# EasyEDA Pro project ProPrj_Avaota A1 八核 AIoT 开发板_2024-05-03.epro, board PCB1 (continued)
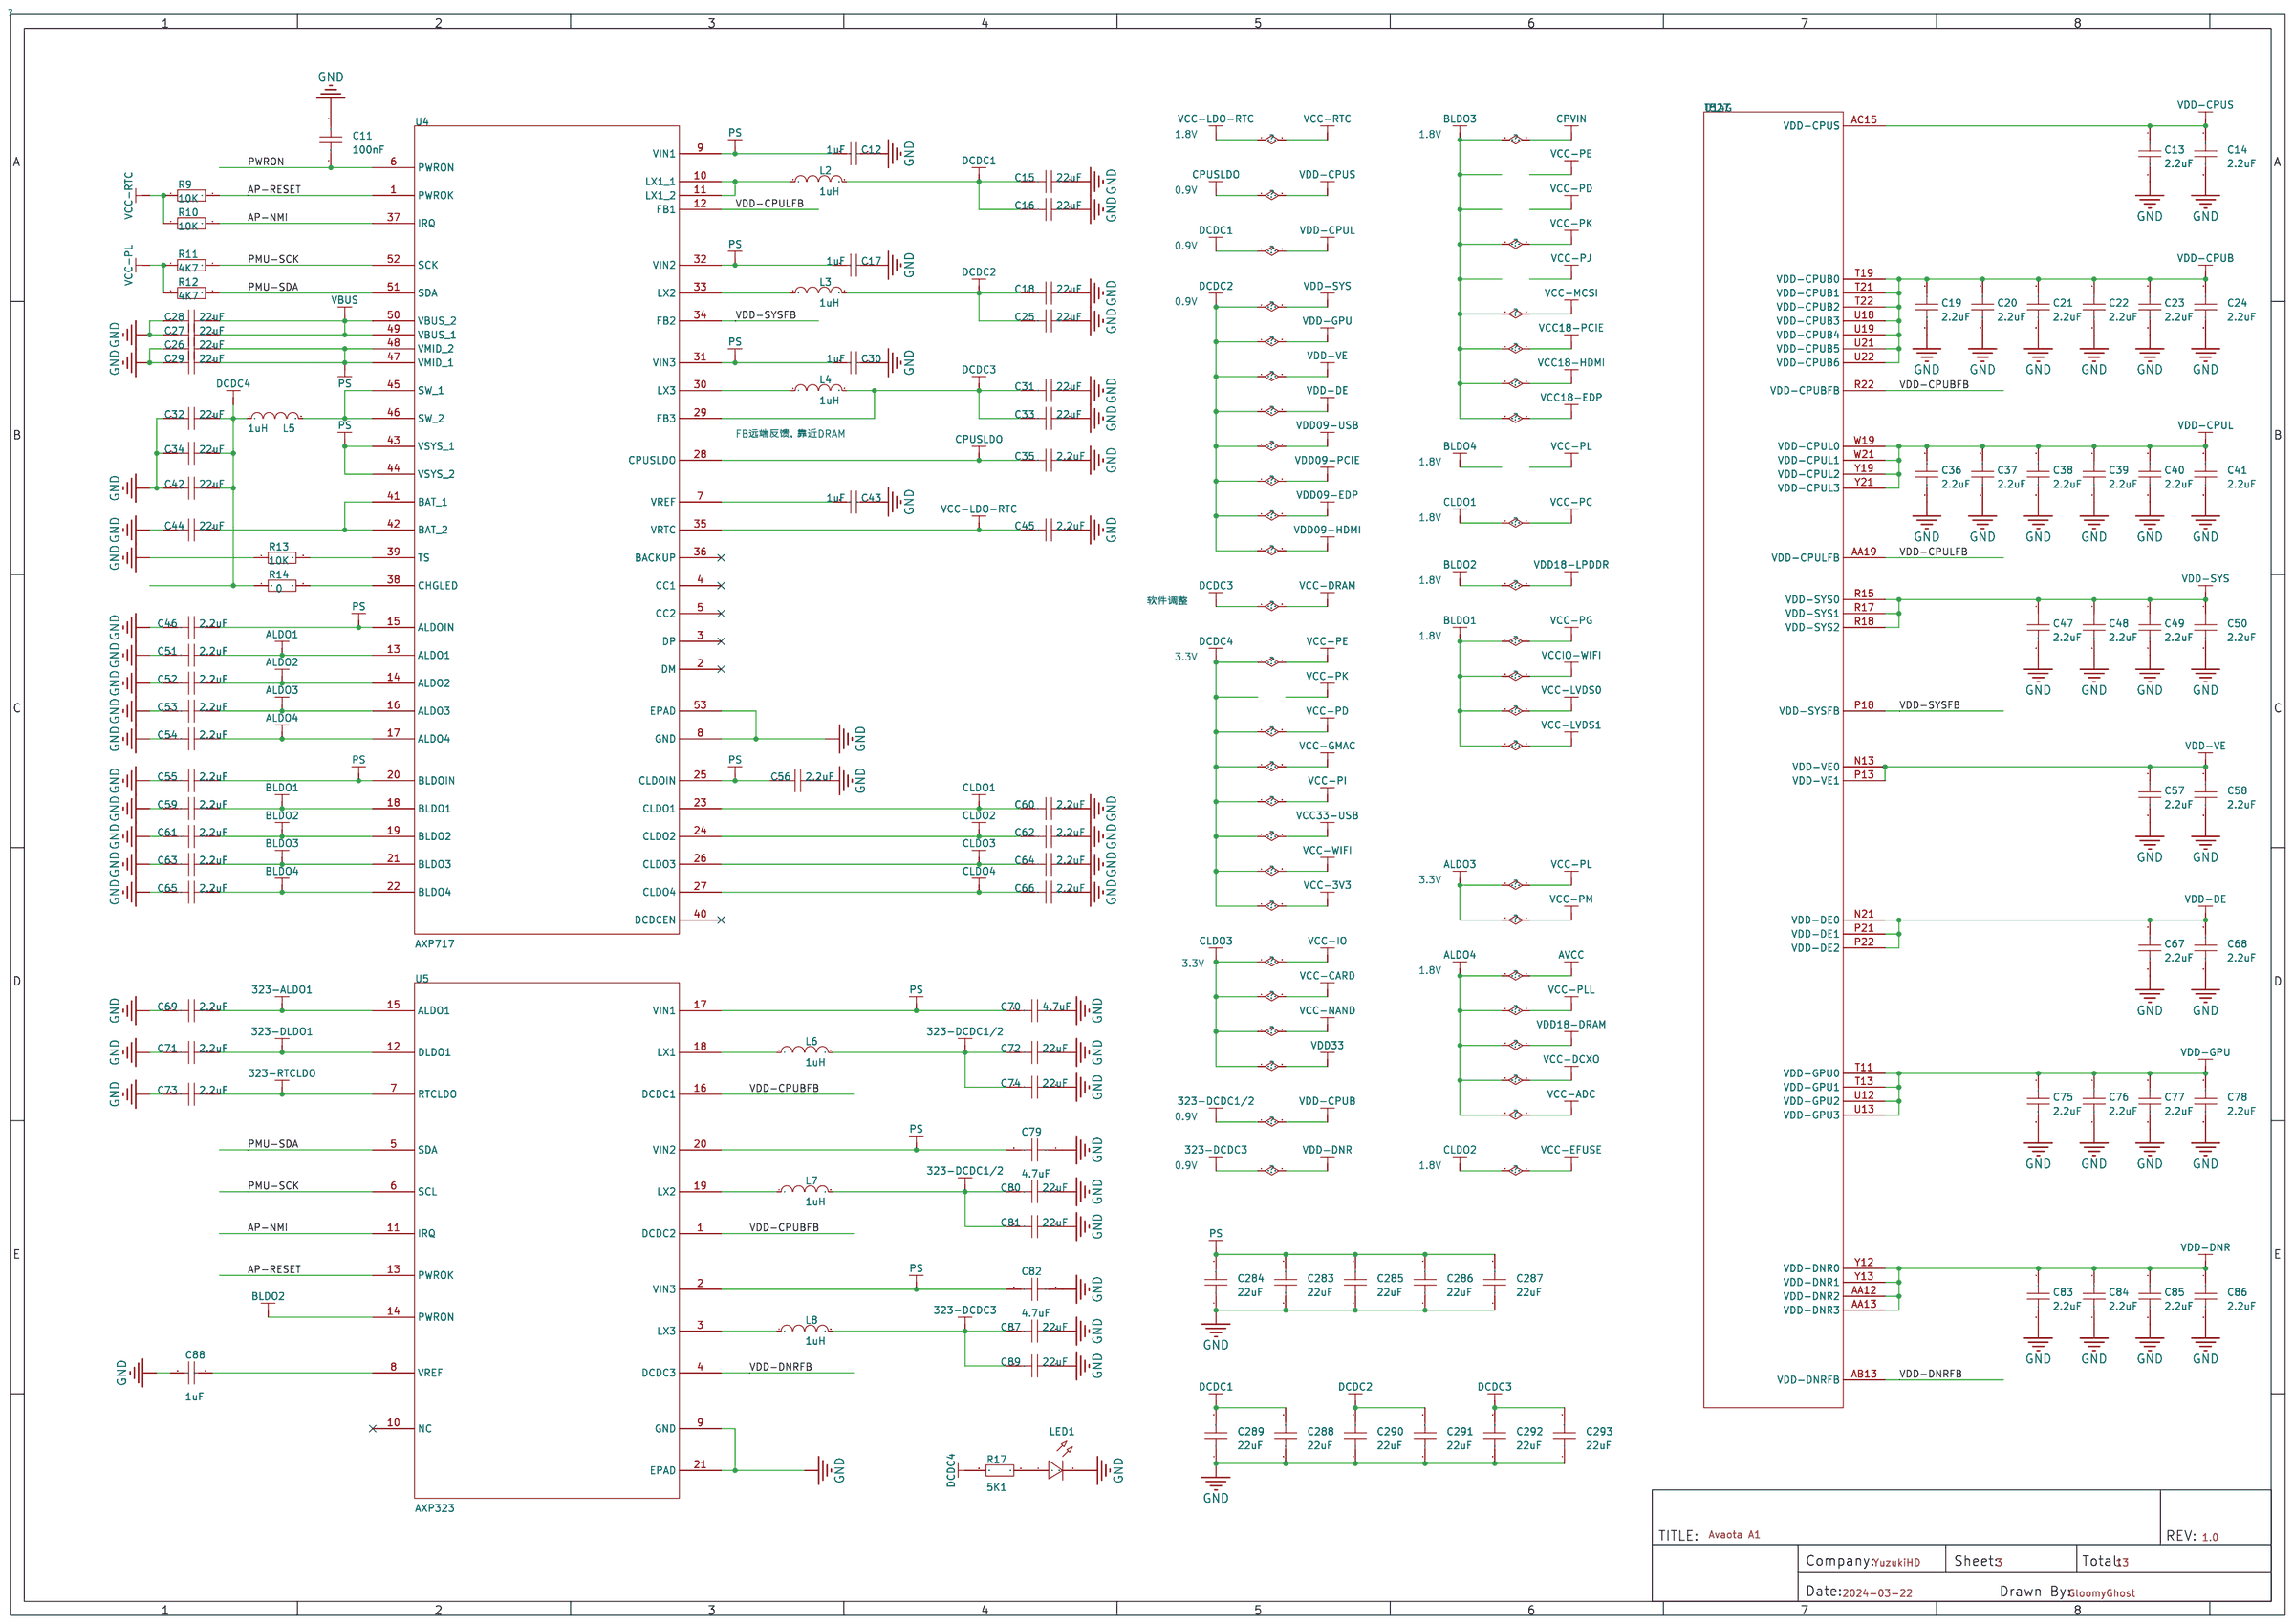
[diagram p0: POWER]
## Routing (per net, layer and track width the routed paths; a pad name or vN(x,y) marks a point on that pad's centre or on a via; arc(x,y) is an arc through that point) (continued)
SDQ3: length 21.4
  Top Layer w0.076: v3(53.92,39.01) 54.48,39.57 54.69,39.57 55.02,39.9 55.7,39.9 55.93,40.14
  Top Layer w0.115: 41.41,43.55 41.72,43.87 42.29,43.87 42.95,43.21 42.95,42.82 43.06,42.71 43.18,42.71 43.39,42.49 43.87,42.49 45.02,41.35 45.74,41.35 46.12,40.97 46.12,40.39 45.79,40.06 44.8,40.06 44.68,39.93 44.68,39.65 44.8,39.52 45.34,39.52 45.49,39.37 45.49,39.06 v3(45.44,39.01)
  内层2 w0.115: v3(45.44,39.01) 45.81,38.64 53.55,38.64 v3(53.92,39.01)
SDQ4: length 18.8
  Top Layer w0.115: 41.41,40.95 41.74,40.61 42.31,40.61 43,39.93 43.68,39.93 v3(44.04,40.29) ; 57.43,41.64 57.9,41.64 v3(57.94,41.68)
  内层2 w0.115: v3(57.94,41.68) 57.83,41.68 57.43,41.27 57.43,40.69 56.69,39.95 53.57,39.95 53.49,40.03 50.7,40.03 50.49,40.23 44.1,40.23 v3(44.04,40.29)
SDQ5: length 21.1
  Top Layer w0.076: 57.93,40.64 57.68,40.39 57.68,40.04 57.55,39.91 57.55,39.42 v3(57.14,39)
  Top Layer w0.115: 40.17,40.62 40.16,40.64 40.11,40.64 39.81,40.95
  内层2 w0.115: v3(40.17,40.62) 40.22,40.58 40.42,40.58 43.2,37.8 55.99,37.8 57.14,38.95 v3(57.14,39)
SDQ6: length 20.8
  Top Layer w0.115: 57.43,41.14 57.4,41.1 v3(56.97,41.1) ; 41.41,41.6 41.75,41.25 42.4,41.25 42.57,41.08 42.57,40.77 42.67,40.67 42.82,40.67 42.9,40.74 42.9,41.13 43.01,41.25 43.14,41.25 43.25,41.13 43.25,40.74 43.34,40.66 43.51,40.66 43.58,40.73 43.58,41.17 43.66,41.25 43.79,41.25 43.89,41.15 43.89,40.67 43.51,40.29 v3(43.36,40.29)
  内层2 w0.115: v3(43.36,40.29) 43.73,40.67 50.95,40.67 51.28,40.33 53.77,40.33 53.92,40.18 56.41,40.18 56.97,40.74 v3(56.97,41.1)
SDQ7: length 23.5
  Top Layer w0.076: v3(57.65,39) 57.65,39.13 57.76,39.24 57.76,39.86 57.86,39.96 57.86,40.07 57.93,40.14
  Top Layer w0.115: 39.81,41.6 39.74,41.6 v3(39.44,41.3)
  内层2 w0.115: v3(39.44,41.3) 39.77,40.97 39.77,40.28 39.5,40 39.5,39.67 41.79,37.38 56.18,37.38 57.65,38.85 v3(57.65,39)
SDQ8: length 28.1
  Top Layer w0.115: v3(58.85,42.88) 58.69,42.88 58.43,43.14 ; UD1.E9 36.35,42.57 36.8,42.57 37.16,42.52 37.49,42.57 v3(37.77,42.87)
  Inner5 w0.115: v3(37.77,42.87) 38.22,43.33 38.68,43.33 39.14,42.87 39.77,42.87 39.85,42.95 40.63,42.95 40.74,43.07 40.74,43.34 40.85,43.46 41.08,43.46 41.2,43.34 41.2,42.93 41.68,42.44 42.19,42.44 42.36,42.62 42.98,42.62 43.09,42.51 43.09,42.43 43.21,42.32 43.44,42.32 43.55,42.43 43.55,42.51 43.67,42.62 43.91,42.62 44.22,42.32 46.25,42.32 46.97,41.6 51.51,41.6 52.35,40.76 56.38,40.76 56.51,40.89 56.51,41.76 56.82,42.06 58.11,42.06 58.34,42.29 58.34,42.77 58.46,42.88 v3(58.85,42.88)
SDQ9: length 28.1
  Top Layer w0.115: 35.81,43.55 35.89,43.46 36.23,43.46 36.46,43.23 37.95,43.23 38.17,43 38.17,42.32 v3(38.56,41.94) ; 58.43,42.64 58.72,42.36 v3(58.82,42.36)
  Inner5 w0.115: v3(58.82,42.36) 58.82,42.21 58.29,41.68 58.29,40.92 57.68,40.31 51.92,40.31 51.46,40.77 46.78,40.77 46.14,41.41 45.98,41.41 45.74,41.17 45.62,41.17 45.49,41.3 45.49,41.44 45.38,41.55 44.47,41.55 44.06,41.15 42.95,41.15 42.47,40.67 41.92,40.67 41.81,40.78 41.81,40.92 40.99,41.73 40.16,41.73 39.62,42.27 38.67,42.27 38.56,42.15 v3(38.56,41.94)
SDQ10: length 26.9
  Top Layer w0.076: v3(58.9,41.64) 58.44,41.64 58.43,41.64
  Top Layer w0.115: 35.81,40.95 36.14,40.61 36.7,40.61 37.06,40.26 37.56,40.26 v3(37.87,40.56)
  Inner5 w0.115: v3(58.9,41.64) 58.83,41.64 58.52,41.33 58.52,40.61 57.99,40.08 51.56,40.08 51.29,40.35 46.7,40.35 46.32,40.73 45.26,40.73 45.15,40.84 45.15,41.06 45.03,41.17 44.81,41.17 44.69,41.06 44.69,40.84 44.58,40.73 43.12,40.73 42.68,40.28 41.54,40.28 41.43,40.4 41.43,40.74 41.25,40.92 40.64,40.92 40.59,40.97 39.7,40.97 39.65,40.92 37.98,40.92 37.87,40.8 v3(37.87,40.56)
SDQ11: length 26.1
  Top Layer w0.115: v3(38.53,40.56) 38.15,40.94 37.59,40.94 37.28,41.25 36.15,41.25 35.81,41.6 ; 58.43,41.14 58.47,41.1 v3(58.9,41.1)
  Inner5 w0.115: v3(38.53,40.56) 38.81,40.56 38.92,40.45 38.92,40.32 39.29,39.96 39.45,39.96 39.7,40.21 40.74,40.21 41.02,39.93 44.37,39.93 44.47,40.03 44.47,40.27 44.59,40.38 44.91,40.38 45.08,40.21 45.51,40.21 45.62,40.31 46.14,40.31 46.25,40.2 46.25,40.03 46.35,39.93 51.14,39.93 51.21,39.85 58.14,39.85 58.9,40.61 v3(58.9,41.1)
SDQ12: length 32.7
  Top Layer w0.115: 34.21,41.6 33.71,41.1 33.71,40.18 v3(33.3,39.78) ; 59.43,40.14 59.43,39.64 v3(59.5,39.57)
  Inner5 w0.115: v3(33.3,39.78) 35.7,37.38 59.09,37.38 59.84,38.12 59.84,38.38 60.22,38.76 60.22,39.12 59.76,39.57 v3(59.5,39.57)
SDQ13: length 31.5
  Top Layer w0.076: 59.27,39.31 59.42,39.25 v3(59.83,38.94) ; 59.27,39.31 59.13,39.45 59.13,39.7 59.18,39.75 59.18,40.89 59.43,41.14 ; 59.27,39.31 arc(59.27,39.31) 59.27,39.3
  Top Layer w0.115: 34.21,40.95 33.91,40.65 33.91,40.05 v3(34.19,39.78)
  Inner5 w0.115: v3(59.83,38.94) 59.83,38.75 59.54,38.46 59.54,38.23 59.1,37.79 35.79,37.79 34.19,39.4 v3(34.19,39.78)
SDQ14: length 32.5
  Top Layer w0.102: 59.43,42.64 59.89,42.64 v3(59.9,42.65)
  Top Layer w0.115: v3(33.88,43.18) 34.21,43.51 34.21,43.55
  Inner5 w0.115: 33.88,43.18 34.14,42.93 34.85,42.93 34.93,43.01 35.48,43.01 36.19,42.29 36.19,40.79 37.89,39.09 44.98,39.09 45.29,39.4 45.59,39.4 45.9,39.09 52.19,39.09 52.5,39.4 58.62,39.4 59.54,40.31 59.54,42.29 v3(59.9,42.65)
SDQ15: length 31.8
  Top Layer w0.115: v3(59.94,43.18) 59.47,43.18 59.43,43.14 ; v3(34.62,43.28) 34.59,43.28 34.21,42.9
  Inner5 w0.115: v3(59.94,43.18) 59.84,43.18 59.26,42.6 59.26,40.46 58.42,39.62 52.19,39.62 52.08,39.51 46.07,39.51 45.76,39.81 45.11,39.81 44.8,39.5 38.02,39.5 36.6,40.92 36.6,42.34 35.66,43.28 v3(34.62,43.28)
SDQ16: length 16.7
  Top Layer w0.076: 51.91,43.57 52.91,43.57 53.23,43.89 53.68,43.89 53.93,44.14
  Top Layer w0.115: UD1.U2 41.71,50.95 41.73,50.98 42.32,51 42.6,50.9 42.85,50.95 43.08,50.85 43.13,50.75 43.26,50.57 v3(43.38,50.22) ; 51.91,43.57 51.79,43.46 49.27,43.46 v3(47.27,45.47)
  内层2 w0.115: v3(43.38,50.22) 43.46,50.22 46.04,47.64 46.04,46.71 47.27,45.48 v3(47.27,45.47)
SDQ17: length 16.5
  Top Layer w0.115: 41.41,51.35 41.74,51.69 43,51.69 v3(43.33,51.36) ; v3(48,45.47) 48.03,45.44 48.03,45.26 49.58,43.71 51.69,43.71 51.86,43.89 52.88,43.89 53.13,44.14 53.43,44.14
  内层2 w0.115: v3(43.33,51.36) 43.33,50.94 46.45,47.81 46.45,46.89 47.88,45.47 v3(48,45.47)
SDQ18: length 24.1
  Top Layer w0.076: 55.93,45.14 55.93,44.75 v3(56.01,44.68)
  Top Layer w0.115: 39.81,50.7 39.78,50.7 v3(39.4,51.08)
  内层2 w0.115: v3(39.4,51.08) 39.14,51.34 39.14,53.14 39.39,53.39 46.2,53.39 51.46,48.13 51.84,48.13 53.62,46.35 53.62,45.97 54.29,45.3 55.54,45.3 56.01,44.83 v3(56.01,44.68)
SDQ19: length 18.9
  Top Layer w0.115: 41.41,52.65 41.54,52.65 41.85,52.96 43.25,52.96 43.72,52.49 43.72,51.36 43.97,51.12 46.06,51.12 v3(46.73,51.79) ; v3(54.96,44.68) 54.96,45.11 54.93,45.14
  内层2 w0.115: v3(46.73,51.79) 46.73,51.78 50.2,48.31 50.54,48.31 53.36,45.49 53.49,45.49 53.92,45.06 54.68,45.06 54.96,44.78 v3(54.96,44.68)
SDQ20: length 21.2
  Top Layer w0.076: v3(39.5,52.98) 39.5,51.66 39.81,51.35
  Top Layer w0.102: 54.43,45.14 v3(54.43,44.68)
  内层2 w0.115: v3(39.5,52.98) 39.52,53.01 45.9,53.01 46.31,52.59 46.31,51.61 50.01,47.92 50.34,47.92 53.02,45.24 53.36,45.24 53.92,44.68 v3(54.43,44.68)
SDQ21: length 17.3
  Top Layer w0.076: 53.93,45.64 53.68,45.89 53.31,45.89 53.21,45.8 52.3,45.8 v3(51.97,45.47)
  Top Layer w0.115: 41.41,53.3 41.49,53.3 41.91,53.72 41.91,54.05 42.11,54.25 42.44,54.25 42.85,53.85 43.63,53.85 45.62,51.87 45.73,51.87 45.84,51.75 v3(45.84,51.66)
  内层2 w0.115: v3(45.84,51.66) 45.84,51.48 49.83,47.5 50.11,47.5 51.97,45.64 v3(51.97,45.47)
SDQ22: length 20.7
  Top Layer w0.076: 51.6,45.99 53.15,45.99 53.3,46.14 53.43,46.14
  Top Layer w0.115: v3(51.38,45.47) 51.43,45.47 51.46,45.49 51.46,45.85 51.6,45.99 ; v3(45.82,52.55) 45.41,52.55 43.74,54.23 43.56,54.23 42.8,54.99 40.64,54.99 40.16,54.51 40.16,53.65 39.81,53.3
  内层2 w0.115: v3(51.38,45.47) 51.38,45.63 49.94,47.08 49.66,47.08 45.43,51.31 45.43,52.16 v3(45.82,52.55)
SDQ23: length 22.2
  Top Layer w0.102: v3(56.55,45.72) 56.53,45.72 56.43,45.82 56.43,45.89 ; 56.43,46.14 56.43,45.89 ; 56.43,45.89 56.43,46.14
  Top Layer w0.115: 39.81,52.65 40,52.65 40.31,52.96 40.71,52.96 40.99,53.24 40.99,53.31 41.3,53.62 41.5,53.62 41.7,53.82 41.7,54.15 42.11,54.56 42.59,54.56 42.69,54.46 v3(42.82,54.46)
  内层2 w0.115: v3(42.82,54.46) 45.72,54.46 51.59,48.59 51.97,48.59 54.4,46.15 56.12,46.15 v3(56.55,45.72)
SDQ24: length 25.9
  Top Layer w0.102: v3(56.54,46.68) 56.43,46.78 56.43,47.14
  Top Layer w0.115: v3(36.17,53.7) 36.17,53.66 35.81,53.3
  Inner5 w0.115: v3(56.54,46.68) 56.54,46.89 55.78,47.65 55.23,47.65 54.51,48.37 54.51,48.39 54.2,48.69 51.51,48.69 49.38,50.83 49.38,50.99 45.37,54.99 37.41,54.99 36.88,54.46 36.88,54.05 36.6,53.77 36.24,53.77 v3(36.17,53.7)
SDQ25: length 27.2
  Top Layer w0.115: 56.01,47.07 55.93,47.14 ; v3(37.69,54.61) 37.39,54.91 35.13,54.91 34.57,54.36 34.57,53.66 34.21,53.3 ; 56.01,47.07 v3(56.01,46.68)
  Inner5 w0.115: v3(56.01,46.68) 56.01,46.79 55.52,47.27 55.01,47.27 53.87,48.41 51.13,48.41 48.96,50.58 48.96,50.81 45.68,54.09 40.73,54.09 40.36,54.46 39.04,54.46 38.81,54.23 38.07,54.23 v3(37.69,54.61)
SDQ26: length 27
  Top Layer w0.102: 54.93,47.14 54.93,46.71 v3(54.96,46.68)
  Top Layer w0.115: 34.21,51.35 34.57,51.71 v3(34.57,51.71)
  Inner5 w0.115: v3(34.57,51.71) 34.21,52.07 34.21,53.19 34.44,53.42 35.05,53.42 35.18,53.29 36.58,53.29 36.96,53.67 37.79,53.67 38.02,53.9 38.96,53.9 39.09,54.03 40.31,54.03 40.66,53.67 45.39,53.67 48.54,50.52 48.54,50.41 50.84,48.11 53.59,48.11 54.96,46.73 v3(54.96,46.68)
SDQ27: length 24.4
  Top Layer w0.115: v3(34.59,53.01) 34.57,53.01 34.21,52.65 ; 54.43,47.14 v3(54.43,46.68)
  Inner5 w0.115: v3(54.43,46.68) 53.77,47.35 51.01,47.35 46.95,51.41 46.56,51.41 46.3,51.66 46.3,51.79 46,52.1 45.62,52.1 44.49,53.23 41.95,53.23 41.81,53.37 40.46,53.37 40.1,53.72 39.22,53.72 39.11,53.62 38.07,53.62 37.82,53.37 37.54,53.37 37.41,53.24 37.41,52.98 37.26,52.83 34.77,52.83 v3(34.59,53.01)
SDQ28: length 21.8
  Top Layer w0.076: 53.93,46.14 53.68,46.39 53.32,46.39 53.11,46.18 51.69,46.18 51.53,46.33 51.16,46.33
  Top Layer w0.115: 51.16,46.33 50.37,46.33 50.09,46.05 49.3,46.05 49.15,45.9 48.33,45.9 47.27,46.96 v3(47.27,47.2) ; 35.81,50.7 35.97,50.7 36.29,51.03 36.75,51.03 37.03,50.75 v3(37.64,50.75)
  Inner5 w0.115: v3(37.64,50.75) 37.64,50.41 37.75,50.29 38.83,50.29 39.16,49.96 39.62,49.96 39.88,50.22 40.49,50.22 40.69,50.01 41.48,50.01 41.55,49.94 42.03,49.94 42.54,49.43 43.12,49.43 43.47,49.07 43.86,49.07 44.09,49.3 44.39,49.3 44.99,48.7 46.09,48.7 46.63,48.16 46.63,47.82 47.26,47.2 v3(47.27,47.2)
SDQ29: length 25
  Top Layer w0.115: 54.43,46.14 v3(54.43,45.68) ; v3(33.8,50.95) 34.06,50.7 34.21,50.7
  Inner5 w0.115: v3(54.43,45.68) 53.96,45.68 53.76,45.88 52.59,45.88 52.18,46.29 48.19,46.29 47.78,46.71 47.14,46.71 45.57,48.29 44.3,48.29 43.93,48.65 43.3,48.65 42.95,49.01 42.45,49.01 41.91,49.56 41.43,49.56 41.25,49.73 40.59,49.73 40.36,49.96 40,49.96 39.78,49.73 39.04,49.73 38.81,49.5 36.68,49.5 36.5,49.33 34.3,49.33 34.19,49.44 34.19,50.57 v3(33.8,50.95)
SDQ30: length 23.2
  Top Layer w0.102: 35.81,52.65 35.91,52.76 36.22,52.76 36.4,52.93 36.78,52.93 36.96,52.86 37.36,52.93 37.72,52.58 38.45,52.58 v3(38.48,52.55) ; 54.93,46.14 54.93,45.71 v3(54.96,45.68)
  Inner5 w0.115: v3(54.96,45.68) 54.59,46.05 53.95,46.05 53.74,46.25 52.65,46.25 52.25,46.66 50.51,46.66 46.72,50.44 45.81,50.44 44.29,51.97 41.65,51.97 41.4,52.22 41.4,52.55 41.22,52.73 40.49,52.73 40.23,52.48 39.04,52.48 38.96,52.55 v3(38.48,52.55)
SDQ31: length 24.9
  Top Layer w0.115: v3(37.79,52.2) 37.79,52.17 37.31,51.68 36.47,51.68 36.13,51.35 35.81,51.35 ; v3(56.01,45.68) 56.01,46.07
  Inner5 w0.115: v3(56.01,45.68) 56.01,45.77 55.5,46.28 54.23,46.28 53.49,47.02 50.75,47.02 46.81,50.95 45.89,50.95 44.04,52.81 41.78,52.81 41.53,53.06 40.18,53.06 39.85,53.39 39.29,53.39 39.01,53.11 39.01,53.02 38.9,52.91 38.28,52.91 37.79,52.43 v3(37.79,52.2)
SDQM0: length 19.5
  Top Layer w0.076: 57.43,40.15 57.39,39.97 57.35,39.74 v3(56.61,39)
  Top Layer w0.115: v3(40.89,41.27) 40.89,41.31 40.61,41.6
  内层2 w0.115: v3(56.61,39) 56.6,39 56.6,38.95 55.87,38.22 43.49,38.22 41.68,40.03 41.68,40.41 40.89,41.2 v3(40.89,41.27)
SDQM1: length 26.3
  Top Layer w0.115: v3(57.94,41.15) 58.43,40.65 58.43,40.64 ; 35.01,41.6 35.32,41.6 35.63,41.91 36.9,41.91 37.01,41.81 37.77,41.81 v3(37.89,41.94)
  Inner5 w0.115: v3(37.89,41.94) 37.74,42.09 37.74,42.32 38.05,42.62 39.65,42.62 40.13,42.14 41.09,42.14 42.06,41.17 42.44,41.17 42.83,41.56 43.98,41.56 44.35,41.94 46.15,41.94 46.9,41.19 51.55,41.19 52.19,40.54 57.33,40.54 v3(57.94,41.15)
SDQM2: length 19.9
  Top Layer w0.076: 53.93,44.64 53.68,44.39 53.02,44.39 52.78,44.14 51.79,44.14
  Top Layer w0.115: v3(44.14,51.54) 44.14,52.7 43.46,53.39 42.62,53.39 42.39,53.62 42.13,53.62 41.78,53.28 41.78,53.21 41.53,52.96 41.02,52.96 40.71,52.65 40.61,52.65 ; v3(48.54,45.47) 48.54,45.18 49.75,43.97 51.46,43.97 51.64,44.14 51.79,44.14
  内层2 w0.115: v3(48.54,45.47) 47.7,46.3 47.63,46.3 46.89,47.05 46.89,47.97 44.17,50.69 44.17,50.7 44.12,50.75 44.12,51.51 v3(44.14,51.54)
SDQM3: length 23.5
  Top Layer w0.076: 53.43,46.64 53.33,46.64 53.06,46.38 51.77,46.38 51.53,46.62
  Top Layer w0.115: v3(47.27,47.78) 47.37,47.78 47.75,47.4 47.75,46.89 48.44,46.2 48.99,46.2 49.07,46.28 49.91,46.28 50.25,46.62 51.53,46.62 ; v3(34.62,52.32) 34.94,52.65 35.01,52.65
  Inner5 w0.115: v3(34.62,52.32) 35,51.94 35,51.49 35.66,50.83 37.16,50.83 37.44,51.1 38.43,51.1 38.81,50.72 39.62,50.72 39.77,50.57 40.49,50.57 40.66,50.75 41.96,50.75 42.31,50.39 42.31,50.19 42.65,49.85 44.43,49.85 45.16,49.12 46.17,49.12 47.01,48.29 47.01,48.03 v3(47.27,47.78)
SDQS0N: length 19.7
  Top Layer w0.076: 56.93,40.14 56.89,40.1 56.89,39.94 56.6,39.65 56.42,39.65 56.14,39.37 55.67,39.37 55.54,39.23 v3(55.54,39.03)
  Top Layer w0.097: v3(40.93,42.57) 40.61,42.9
  内层2 w0.127: v3(55.54,39.03) 55.54,39.18 55.03,39.69 52.26,39.69 52.09,39.52 48.54,39.52 48.33,39.73 43.23,39.73 42.53,40.43 42.53,40.68 41.22,42 40.8,42 40.63,42.18 40.63,42.45 40.75,42.57 v3(40.93,42.57)
SDQS0P: length 20.1
  Top Layer w0.076: 56.93,40.64 56.93,40.5 56.69,40.26 56.69,40.03 56.49,39.83 56.34,39.83 56.06,39.55 55.5,39.55 v3(54.98,39.03)
  Top Layer w0.127: 40.61,42.25 40.58,42.25 v3(40.26,42.57)
  内层2 w0.127: v3(40.26,42.57) 40.33,42.5 40.33,42.06 40.68,41.71 41.1,41.71 42.24,40.56 42.24,40.31 43.11,39.44 48.21,39.44 48.42,39.23 52.21,39.23 52.38,39.4 54.61,39.4 v3(54.98,39.03)
SDQS1N: length 30.2
  Top Layer w0.076: v3(59.23,38.96) 58.93,39.26 58.93,40.14
  Top Layer w0.127: 35.01,42.9 35.01,42.88 v3(34.69,42.57)
  Inner5 w0.127: v3(34.69,42.57) 34.69,42.57 34.8,42.47 34.8,42.19 35.01,41.97 35.01,39.46 36.17,38.3 58.88,38.3 59.18,38.59 59.18,38.91 v3(59.23,38.96)
SDQS1P: length 30.3
  Top Layer w0.076: 58.93,40.64 58.68,40.39 58.69,40.05 58.69,39.72 ; v3(58.67,38.96) 58.67,39.09 58.68,39.1 58.68,39.26 58.61,39.34 58.47,39.34 58.37,39.43 58.37,39.54 58.47,39.64 58.61,39.64 58.68,39.72
  Top Layer w0.127: v3(35.33,42.57) 35.01,42.25
  Inner5 w0.127: v3(58.67,38.96) 58.76,38.96 58.89,38.84 58.89,38.72 58.76,38.59 36.29,38.59 35.3,39.58 35.3,42.09 35.09,42.31 35.09,42.44 35.22,42.57 v3(35.33,42.57)
SDQS2N: length 18.8
  Top Layer w0.076: 50.53,44.6 52.2,44.6 52.78,45.19 53.1,45.19 53.17,45.11 53.17,45.03 53.25,44.95 53.36,44.95 53.43,45.03 53.43,45.14
  Top Layer w0.127: v3(49.66,45.47) 49.76,45.47 49.93,45.29 49.93,44.93 50.26,44.6 50.53,44.6 ; 40.61,51.35 40.99,51.74 v3(40.99,51.76)
  内层2 w0.127: v3(40.99,51.76) 40.99,51.83 41.12,51.96 41.28,51.96 41.49,51.74 43.53,51.74 43.9,52.11 44.36,52.11 44.63,51.83 44.63,50.95 47.69,47.89 47.69,47.03 48.79,45.92 49.72,45.92 49.9,45.74 49.9,45.61 49.76,45.47 v3(49.66,45.47)
SDQS2P: length 18.8
  Top Layer w0.076: 53.93,45.14 53.68,45.39 52.7,45.39 52.11,44.81 50.8,44.81 50.69,44.91 50.59,44.91
  Top Layer w0.127: v3(50.24,45.47) 50.19,45.41 50.19,45.03 50.32,44.91 50.58,44.91 50.59,44.91 ; v3(40.99,52.35) 40.98,52.34 40.95,52.34 40.61,52
  内层2 w0.127: v3(50.24,45.47) 50.19,45.52 50.19,45.87 49.84,46.21 48.91,46.21 47.98,47.15 47.98,48.01 44.92,51.07 44.92,51.96 44.48,52.4 43.78,52.4 43.41,52.03 41.62,52.03 41.4,52.25 41.09,52.25 v3(40.99,52.35)
SDQS3N: length 22.2
  Top Layer w0.076: 51.57,47.14 52.04,47.14 52.12,47.07 52.12,46.89 52.2,46.82 52.35,46.82 52.42,46.89 52.42,47.07 52.5,47.14 53.43,47.14
  Top Layer w0.127: v3(48.75,46.9) 48.99,47.14 51.57,47.14 ; 35.01,51.35 35.01,51.35 v3(35.35,51.69)
  Inner5 w0.127: v3(35.35,51.69) 35.35,51.82 35.48,51.94 35.68,51.94 35.92,51.7 37.22,51.7 37.38,51.54 38.05,51.54 38.38,51.87 39.8,51.87 40.56,51.1 42.01,51.1 42.47,50.65 44.4,50.65 45.41,49.63 46.41,49.63 47.65,48.4 47.65,47.55 48.14,47.05 48.58,47.05 48.73,46.9 v3(48.75,46.9)
SDQS3P: length 22.1
  Top Layer w0.076: 51.57,47.4 51.67,47.4 51.72,47.35 53.15,47.35 53.2,47.39 53.57,47.39 53.82,47.14 53.93,47.14
  Top Layer w0.127: v3(48.74,47.41) 48.76,47.4 51.57,47.4 ; v3(35.41,52.37) 35.03,52 35.01,52
  Inner5 w0.127: v3(48.74,47.41) 48.67,47.35 48.26,47.35 47.94,47.67 47.94,48.52 46.54,49.92 45.53,49.92 44.52,50.94 42.56,50.94 42.1,51.4 40.68,51.4 39.92,52.16 38.26,52.16 37.93,51.83 37.5,51.83 37.34,51.99 36.04,51.99 35.8,52.23 35.55,52.23 v3(35.41,52.37)
SPI0-CLK: length 19.1
  Top Layer w0.102: R123.1 65.23,59.6 65.23,64.01 64.82,64.41 64.82,65.02 64.26,65.58 61.32,65.58 arc(61.18,65.64) 61.13,65.77 61.13,66.08 arc(60.94,66.27) 60.75,66.08 60.75,65.77 arc(60.56,65.58) 60.36,65.77 60.36,66.08 arc(60.17,66.27) 59.98,66.08 59.98,65.77 arc(59.79,65.58) 59.6,65.77 59.6,66.08 arc(59.41,66.27) 59.22,66.08 59.22,65.77 arc(59.17,65.64) 59.03,65.58 58.95,65.58 58.75,65.38 58.27,65.38 57.89,65 57.89,63.98 v1(58.42,63.45)
  Bottom Layer w0.102: 57.49,63.73 58.14,63.73 v1(58.42,63.45)
SPI0-CS: length 20.7
  Top Layer w0.076: 65.68,58.9 65.68,58.77 65.53,58.62 65.53,57.22 65.2,56.88 65.2,55.4 64.94,55.14
  Top Layer w0.102: 65.68,58.9 65.68,59.69 65.48,59.89 65.48,64.31 65.13,64.67 65.13,65.33 64.49,65.96 63.37,65.96 63.09,66.24 61.85,66.24 61.72,66.37 61.72,66.7 61.85,66.83 63.25,66.83 v1(63.68,66.4)
  Bottom Layer w0.102: R73.1 65.09,66.73 65.42,66.4 ; 65.42,66.4 v1(63.68,66.4) ; 65.42,66.4 65.55,66.27
SPI0-HOLD: length 15.9
  Top Layer w0.076: 64.24,58.99 64.24,58.45 63.88,58.09 63.88,56.08 63.44,55.64
  Top Layer w0.102: v1(58.62,64.59) 60.02,63.2 63.3,63.2 64.24,62.26 64.24,58.99
  Bottom Layer w0.102: R75.1 57.47,65.01 57.49,65 58.22,65 v1(58.62,64.59)
SPI0-MISO: length 16.7
  Top Layer w0.076: 64.72,58.11 64.34,57.73 64.34,56.25 64.44,56.15 ; 64.72,58.11 64.72,58.8
  Top Layer w0.102: 64.72,58.8 64.72,62.66 63.37,64.01 63.37,64.36 63.47,64.47 v1(63.73,64.47)
  Bottom Layer w0.102: 65.55,65 65.55,64.56 65.46,64.47 64.8,64.47 64.49,64.77 64.49,65.79 64.4,65.88 64.28,65.88 64.19,65.79 64.19,64.82 64.1,64.74 63.96,64.74 63.88,64.82 63.88,65.79 63.75,65.91 63.6,65.91 63.47,65.79 63.47,64.69 63.7,64.47 v1(63.73,64.47)
SPI0-MOSI: length 20.7
  Top Layer w0.076: 64.96,58.85 64.96,58.03 64.54,57.61 64.54,56.39 64.7,56.24 64.7,56.05 64.44,55.79 64.44,55.65
  Top Layer w0.102: v1(58.88,63.07) 58.88,63.5 58.17,64.21 58.17,64.87 58.37,65.08 59.77,65.08 60.5,64.34 62.26,64.34 63.17,65.25 64.03,65.25 64.47,64.82 64.47,64.21 64.96,63.72 64.96,58.85
  Bottom Layer w0.102: 57.49,62.46 58.27,62.46 v1(58.88,63.07)
SPI0-WP: length 19.5
  Top Layer w0.076: 63.94,55.64 64.1,55.8 64.1,57.99 64.47,58.37 64.47,58.98
  Top Layer w0.102: 64.47,58.98 64.47,62.48 63.04,63.91 63.04,64.57 63.35,64.87 63.83,64.87 64.08,64.62 64.08,63.91 v1(64.24,63.75)
  Bottom Layer w0.102: R74.1 66.74,63.73 65.55,63.73 65.86,63.42 65.86,63.22 65.71,63.07 64.54,63.07 64.31,63.3 64.11,63.3 63.98,63.17 63.98,62.16 63.88,62.05 63.68,62.05 63.55,62.18 63.55,63.37 63.93,63.75 v1(64.24,63.75)
SPI-LCD-BLK: length 92.5
  Top Layer w0.102: v2(52.45,52.78) 52.81,52.78 U14.AN9
  内层2 w0.127: v2(46.76,64.26) 46.91,64.26 47.19,64.54 47.19,65.35 49.05,67.21 53.39,67.21 58.29,62.31 62.13,62.31 63.2,63.37 64.59,63.37 64.87,63.65 89.56,63.65 92.91,60.3 v2(92.91,54.1)
  Bottom Layer w0.102: H1.32 46.18,73.23 47.24,72.16 47.24,69.85 46.76,69.37 v2(46.76,64.26) 46.76,61.34 47.8,60.3 47.8,59.51 48.92,58.39 48.92,56.79 50.55,55.17 50.55,54.58 52.35,52.78 v2(52.45,52.78)
  Bottom Layer w0.127: v2(92.91,54.1) 87.88,54.1 86.82,53.04 U16.4
SPI-LCD-CLK: length 95.8
  Top Layer w0.102: U14.AJ9 54.94,52.65 v1(54.94,52.65)
  Top Layer w0.127: v2(92.07,45.72) 92.91,44.89 TFT1.4
  内层2 w0.127: v2(47.75,63.47) 47.98,63.7 47.98,64.8 49.66,66.47 52.88,66.47 57.78,61.57 62.74,61.57 63.78,62.61 65.1,62.61 65.41,62.92 89.08,62.92 92,60 92,53.65 92.53,53.11 92.53,49.94 91.41,48.82 91.41,48.29 92.05,47.65 92.05,45.75 v2(92.07,45.72)
  Bottom Layer w0.102: H1.36 51.08,73.08 49.89,71.88 49.89,70.26 48.92,69.29 48.34,69.29 47.75,68.71 v2(47.75,63.47) 47.75,61.44 48.41,60.78 48.41,59.84 49.58,58.67 49.58,57.12 51.18,55.52 51.18,54.92 52.53,53.57 52.68,53.57 53.26,52.98 54.18,52.98 54.25,53.06 54.53,53.06 v1(54.94,52.65)
SPI-LCD-CS: length 93.9
  Top Layer w0.102: U14.AK9 v1(54.43,52.65)
  Top Layer w0.127: TFT1.7 90.81,45.19 v2(90.91,45.29)
  内层2 w0.127: v2(47.24,63.86) 47.32,63.86 47.57,64.11 47.57,64.97 49.4,66.8 53.14,66.8 58.01,61.93 62.38,61.93 63.45,62.99 64.85,62.99 65.13,63.27 89.36,63.27 92.46,60.17 92.46,53.75 92.91,53.29 92.91,49.63 92.46,49.17 92.46,45.47 92.18,45.19 91.9,45.19 91.57,45.52 91.14,45.52 v2(90.91,45.29)
  Bottom Layer w0.102: 48.54,70.69 48.54,70.36 47.24,69.06 v2(47.24,63.86) 47.24,61.39 48.11,60.53 48.11,59.66 49.25,58.52 49.25,57 50.88,55.37 50.88,54.76 52.48,53.16 52.65,53.16 53.16,52.65 v1(54.43,52.65)
SPI-LCD-DC: length 94.1
  Top Layer w0.102: v1(54.97,53.62) U14.AJ7
  Top Layer w0.127: v2(91.57,46.18) 91.57,45.54 92.2,44.9 TFT1.5
  内层2 w0.127: v2(48.72,62.69) 48.72,64.41 50.09,65.79 52.58,65.79 57.51,60.86 63.32,60.86 64.29,61.82 65.46,61.82 65.81,62.18 88.62,62.18 91.03,59.77 91.03,53.21 91.77,52.48 91.77,50.52 90.58,49.33 90.58,47.47 91.57,46.48 v2(91.57,46.18)
  Bottom Layer w0.076: 53.52,53.67 54,53.67 54.28,53.95 54.64,53.95 v1(54.97,53.62)
  Bottom Layer w0.102: H1.38 52.91,72.52 52.88,72.52 52.43,72.06 52.43,69.98 51.84,69.39 50.52,69.39 49.48,68.35 49,68.35 48.72,68.07 v2(48.72,62.69) 48.72,61.54 49.05,61.21 49.05,60.15 50.29,58.9 50.29,57.46 51.82,55.93 51.82,55.37 53.52,53.67
SPI-LCD-MOSI: length 91.5
  Top Layer w0.102: U14.AK7 54.47,53.62 v1(54.46,53.62)
  Top Layer w0.127: TFT1.3 93.6,45.1 v2(91.62,47.09)
  内层2 w0.127: v2(48.21,63.07) 48.34,63.2 48.34,64.57 49.89,66.12 52.73,66.12 57.66,61.19 63.04,61.19 64.11,62.26 65.3,62.26 65.61,62.56 88.85,62.56 91.49,59.92 91.49,53.47 92.18,52.78 92.18,50.27 91.01,49.1 91.01,47.7 v2(91.62,47.09)
  Bottom Layer w0.102: v1(54.46,53.62) 54.1,53.26 53.49,53.26 52.81,53.95 52.65,53.95 51.49,55.12 51.49,55.73 49.94,57.28 49.94,58.8 48.72,60.02 48.72,61.06 48.21,61.57 v2(48.21,63.07) 48.21,68.43 48.64,68.86 49.23,68.86 51.05,70.69 51.08,70.69
SPI-LCD-RST: length 95
  Top Layer w0.076: v1(52.45,52.25) 52.96,52.25 53.31,51.89 53.69,51.89 U14.AM9
  Top Layer w0.127: v2(91.52,44.86) 91.52,42.37 TFT1.6
  内层2 w0.127: v2(91.52,44.86) 91.67,44.7 92.35,44.7 92.86,45.21 92.86,47.24 93.37,47.75 93.37,60.4 89.71,64.06 64.77,64.06 64.67,64.16 64.06,64.16 63.75,63.86 62.99,63.86 61.77,62.64 58.55,62.64 53.59,67.59 48.89,67.59 46.35,65.05 v2(46.35,64.74)
  Bottom Layer w0.102: v1(52.45,52.25) 50.24,54.46 50.24,55.09 48.62,56.72 48.62,58.29 47.55,59.36 47.55,60.05 46.35,61.24 v2(46.35,64.74) 46.35,70.33 46,70.69
SRST: length 27.9
  Top Layer w0.076: 56.43,45.14 56.43,44.87 56.54,44.76 56.54,44.68 v3(56.56,44.66)
  Top Layer w0.102: v3(34.63,50.27) 34.62,50.25 34.61,50.25 34.59,50.24 34.4,50.24 34.21,50.05
  内层2 w0.115: v3(56.56,44.66) 56.22,44.32 52.7,44.32 52.17,44.86 47.22,44.86 45.97,46.1 45.54,46.1 45.31,46.33 45.31,46.74 45.59,47.02 45.59,47.49 44.77,48.31 44.22,48.31 42.24,50.29 42.24,50.52 41.93,50.83 40.71,50.83 40.46,50.57 40,50.57 39.85,50.72 38.89,50.72 38.45,50.29 37.36,50.29 36.75,50.9 35.27,50.9 v3(34.63,50.27)
STWI1-SCK: length 27.6
  Top Layer w0.076: 51.26,56.59 51.99,55.85 51.99,54.94 52.54,54.4 53.69,54.4 53.92,54.63
  Top Layer w0.102: v2(46.86,57.48) 47.17,57.18 50.67,57.18 51.26,56.59
  Bottom Layer w0.102: 41.92,72.21 41.63,72.49 ; 41.92,72.21 42.24,71.88 42.24,70.13 43.18,69.19 43.18,67.06 45.54,64.69 45.54,60.88 46.76,59.66 46.76,57.58 v2(46.86,57.48) ; 41.92,72.21 41.92,72.23 H1.28
STWI1-SDA: length 22.9
  Top Layer w0.076: 53.69,54.89 52.7,54.89
  Top Layer w0.102: v2(47.32,57.84) 47.68,57.48 50.9,57.48 52.32,56.06 52.32,55.27 52.7,54.89 ; U14.AM3 53.69,54.89
  Bottom Layer w0.102: 43.46,70.69 43.51,70.64 43.51,67.16 45.9,64.77 45.9,61.06 47.19,59.77 47.19,57.96 v2(47.32,57.84)
UART1-CTS: length 54.7
  Top Layer w0.076: v1(19.66,61.21) 19.43,61.44 19.43,65.74 19.74,66.04 U9.41
  Top Layer w0.102: v1(61.95,53.65) U14.U6
  Inner5 w0.102: v1(61.95,53.65) 62.56,54.26 62.56,54.89 62.2,55.25 61.04,55.25 58.17,58.12 56.59,58.12 55.25,59.46 49.2,59.46 45.26,63.4 21.84,63.4 v1(19.66,61.21)